# EasyEDA Pro project 3SE_24_Power_Rune.eprj, board Armour (continued)
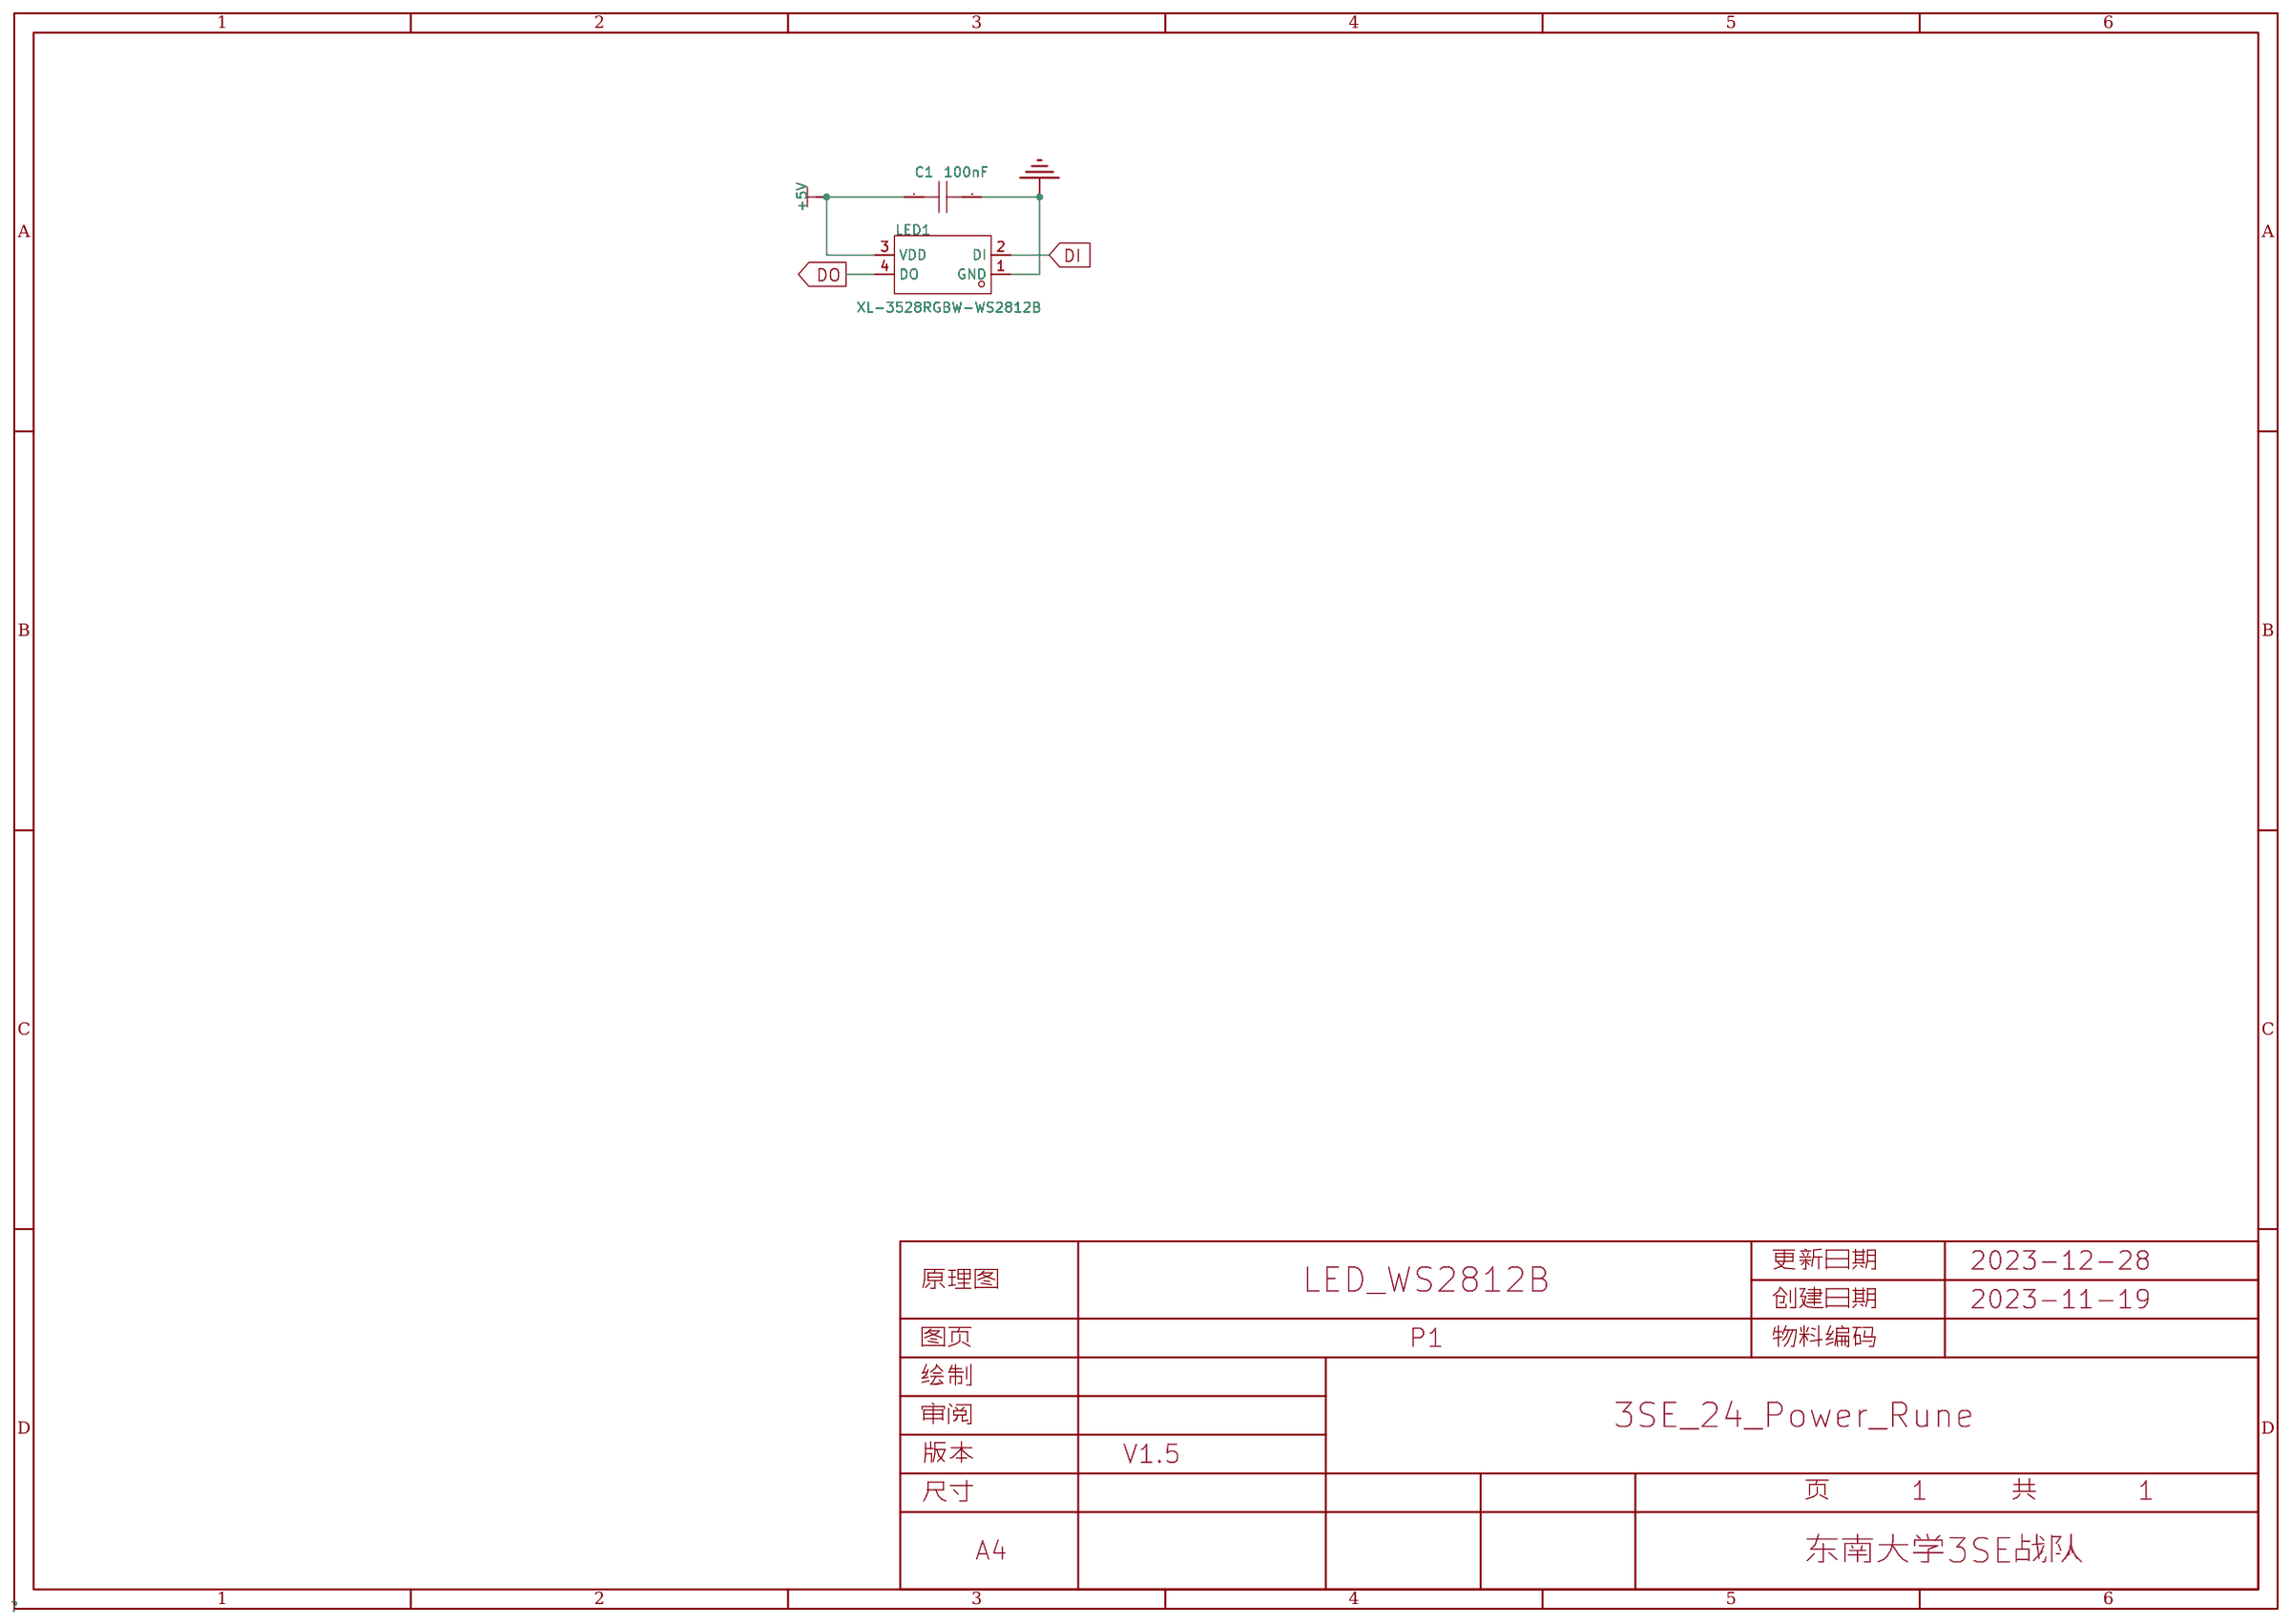
[diagram p0: schematic sheet]
## Routing (per net, layer and track width the routed paths; a pad name or vN(x,y) marks a point on that pad's centre or on a via; arc(x,y) is an arc through that point) (continued)
$1N27067: length 14.6
  Top Layer w0.254: LED94.2 169.77,307.99 LED93.4
$1N27068: length 14.3
  Top Layer w0.254: LED94.4 164.3,304.25 LED95.2
$1N27069: length 24.2
  Top Layer w0.254: LED96.2 132.82,295.24 133.83,296.25 133.83,300.86 136.2,303.23 149.83,303.23 LED95.4
$1N27071: length 16.2
  Top Layer w0.254: LED93.2 187.6,309.49 191,306.09 201.33,306.09 LED92.4
$1N27073: length 16.6
  Top Layer w0.254: LED97.4 118.12,283.26 111.23,276.37 107.87,276.37 LED98.2
$1N27074: length 16.3
  Top Layer w0.254: LED98.4 99.47,269.8 99.47,264.8 97.79,263.11 LED99.2
$1N27075: length 22
  Top Layer w0.254: LED96.4 136.14,296.75 136.63,296.25 136.63,293.59 131.04,288 LED97.2
$1N27077: length 19.7
  Top Layer w0.254: LED88.4 262.38,275.03 258.03,279.38 258.03,286.05 256.08,288 LED89.2
$1N29007: length 21.9
  Top Layer w0.254: LED101.2 78.34,229.64 78.62,229.92 78.62,231.99 79.82,233.19 79.82,237.12 78.91,238.04 78.91,241.7 LED100.4
$1N29008: length 19.7
  Top Layer w0.254: LED101.4 80.86,231.14 81.36,230.64 81.36,219.81 LED102.2
$1N29009: length 18.9
  Top Layer w0.254: LED103.2 77.36,199.6 77.36,207.63 73.13,211.86 LED102.4
$1N29011: length 17.4
  Top Layer w0.254: LED105.2 79.9,168.08 73.13,174.84 LED104.4
$1N29012: length 23.5
  Top Layer w0.254: LED105.4 77.93,161.79 78.76,160.96 78.76,146.59 81.78,143.57 LED106.2
$1N29013: length 18.3
  Top Layer w0.254: LED107.2 96.23,137.04 88.21,145.07 LED106.4
$1N29015: length 17.9
  Top Layer w0.254: LED103.4 71.75,190.5 76.13,186.12 LED104.2
$1N29017: length 28.6
  Top Layer w0.254: LED108.4 106.74,113.9 108.73,113.9 115.54,107.08 115.54,102.38 116.61,101.32 118.35,101.32 119.74,102.71 119.74,105.14 120.58,105.97 LED109.2
$1N29018: length 30
  Top Layer w0.254: LED109.4 117.61,104.47 116.6,105.49 116.6,107.62 118.94,109.96 124.85,109.96 134.86,99.96 LED110.2
$1N29019: length 21
  Top Layer w0.254: LED107.4 98.47,124.12 103.82,124.12 107.7,120.25 LED108.2
$1N29021: length 15.5
  Top Layer w0.254: LED100.2 93.23,254.52 LED99.4
$1N29157: length 19.4
  Top Layer w0.254: LED112.2 169.65,88.66 168.67,89.65 LED111.4
$1N29158: length 26.1
  Top Layer w0.254: LED112.4 171.62,79.4 183.88,79.4 185.76,81.28 185.76,83.55 186.7,84.49 LED113.2
$1N29159: length 36.3
  Top Layer w0.254: LED114.2 204.13,85.87 203.18,84.92 203.18,82.83 200.74,80.39 197.29,80.39 194.55,83.12 194.55,86.07 192.09,88.54 184.94,88.54 182.48,86.07 182.48,83.99 183.48,82.99 LED113.4
$1N29161: length 24.1
  Top Layer w0.254: LED116.2 238.7,97.21 237.58,96.09 237.58,91.53 235.7,89.65 LED115.4
$1N29162: length 40
  Top Layer w0.254: LED116.4 235.72,95.71 234.27,97.15 234.27,99.1 245.56,110.4 256.58,110.4 257.61,109.37 257.61,107 256.58,105.97 LED117.2
$1N29163: length 29.4
  Top Layer w0.254: LED117.4 253.38,101.47 258.81,101.47 265.26,107.92 265.26,116.74 265.96,117.44 LED118.2
$1N29165: length 24.8
  Top Layer w0.254: LED115.2 217.49,88.15 216.78,88.86 200.2,88.86 199.33,87.98 199.33,85.25 200.2,84.37 LED114.4
$1N29167: length 23.7
  Top Layer w0.254: LED119.4 274.75,129.36 273.1,131.01 273.1,138.76 278.01,143.67 LED120.2
$1N29168: length 22.8
  Top Layer w0.254: LED121.2 295.07,162.85 296.64,161.28 296.64,155.93 292.42,151.71 292.42,150.41 LED120.4
$1N29169: length 29.1
  Top Layer w0.254: LED118.4 261.97,115.94 261.9,115.87 260.68,117.09 260.68,118.62 268.09,126.04 275.02,126.04 276.81,127.83 276.81,129.99 277.69,130.87 278.26,130.87 LED119.2
$1N29171: length 29.3
  Top Layer w0.254: LED111.2 149.98,88.15 148.99,89.14 148.99,95.65 145.5,99.14 140.25,99.14 135.82,94.71 133.03,94.71 LED110.4
$1N29307: length 24.3
  Top Layer w0.254: LED123.2 285.74,196.99 293.63,189.1 293.63,179.22 294.96,177.89 LED122.4
$1N29308: length 23.7
  Top Layer w0.254: LED124.2 284.3,213.92 285.36,212.86 285.36,205.75 279.43,199.81 279.43,197.24 281.18,195.49 LED123.4
$1N29309: length 13.2
  Top Layer w0.254: LED125.2 277.23,223.17 277.23,214.27 279.08,212.42 LED124.4
$1N29311: length 19.4
  Top Layer w0.254: LED127.2 263.06,259.66 267.19,255.53 267.19,244.85 267.8,244.24 LED126.4
$1N29312: length 19.2
  Top Layer w0.254: LED127.4 257.13,258.16 251.96,263.33 251.96,271.06 251.39,271.63 249.96,271.63 LED128.2
$1N29313: length 18
  Top Layer w0.254: LED129.2 237.26,281.42 239.56,279.13 239.56,274.98 244.36,270.17 LED128.4
$1N29315: length 27.2
  Top Layer w0.254: LED126.2 272.82,245.74 272.91,245.83 273.63,245.11 273.63,243.14 272.5,242.01 272.5,232.81 274.91,230.41 276.67,230.41 280.58,226.5 LED125.4
$1N29317: length 9.4
  Top Layer w0.254: LED131.2 206.18,293 210.21,288.98 LED130.4
$1N29318: length 15.2
  Top Layer w0.254: LED132.2 187.5,294.49 190.48,291.5 LED131.4
$1N29319: length 27.3
  Top Layer w0.254: LED129.4 232.3,279.23 220.37,279.23 218.65,280.94 218.65,288.28 216.45,290.48 LED130.2
$1N29321: length 23.8
  Top Layer w0.254: LED122.2 297.71,179.39 296.77,178.44 296.77,175.75 289.33,168.31 289.33,162.18 290.16,161.35 LED121.4
$1N29457: length 9.5
  Top Layer w0.254: LED133.4 164.57,288.75 161.2,288.75 LED134.2
$1N29458: length 23.7
  Top Layer w0.254: LED135.2 139.97,282.9 154.95,282.9 156.64,284.59 LED134.4
$1N29459: length 14.3
  Top Layer w0.254: LED135.4 127.25,271.67 LED136.2
$1N29461: length 15.2
  Top Layer w0.254: LED138.2 109.56,252.48 LED137.4
$1N29462: length 30.8
  Top Layer w0.254: LED139.2 91.88,223.79 92.52,224.43 92.52,226.44 94.48,228.4 99.97,228.4 103.33,231.76 103.33,240.72 LED138.4
$1N29463: length 14.1
  Top Layer w0.254: LED139.4 94.57,225.29 95.48,224.38 95.48,218.16 LED140.2
$1N29465: length 15.9
  Top Layer w0.254: LED137.2 115.29,259.66 121.58,265.94 LED136.4
$1N29467: length 17.3
  Top Layer w0.254: LED141.4 86.75,190.89 91.23,186.4 LED142.2
$1N29468: length 12.5
  Top Layer w0.254: LED142.4 89.27,178.55 93.95,173.88 93.95,169.3 LED143.2
$1N29469: length 17.1
  Top Layer w0.254: LED140.4 88.23,210.49 91.04,207.69 91.04,198.28 LED141.2
$1N29471: length 13.9
  Top Layer w0.254: LED132.4 170.34,292.99 LED133.2
$1N29607: length 29.4
  Top Layer w0.254: LED144.4 99.81,136.48 106.64,129.66 110.13,129.66 111.16,130.68 111.16,133.48 112,134.31 LED145.2
$1N29608: length 31.9
  Top Layer w0.254: LED146.2 124.58,126.52 113.08,138.02 108.79,138.02 107.67,136.9 107.67,133.61 108.46,132.81 LED145.4
$1N29609: length 22.1
  Top Layer w0.254: LED147.2 138.5,115.52 134.85,119.17 123.21,119.17 LED146.4
$1N29611: length 15.8
  Top Layer w0.254: LED148.4 159.69,103.54 165.83,97.4 167.71,97.4 168.83,98.52 168.83,99.88 169.92,100.97 LED149.2
$1N29612: length 31.1
  Top Layer w0.254: LED149.4 166.61,99.47 165.79,100.29 165.79,103.01 167.63,104.85 185.18,104.85 187.41,102.62 187.41,99.65 LED150.2
$1N29613: length 25.4
  Top Layer w0.254: LED150.4 187.44,94.8 199.98,94.8 202.86,97.68 202.86,100.36 203.32,100.82 204.03,100.82 LED151.2
$1N29615: length 27.3
  Top Layer w0.254: LED148.2 154.48,100.19 144.35,100.19 135.5,109.04 LED147.4
$1N29617: length 27.8
  Top Layer w0.254: LED152.4 215.23,107.74 216.75,109.26 233.69,109.26 234.37,109.94 234.37,111.44 235.48,112.55 LED153.2
$1N29618: length 30.1
  Top Layer w0.254: LED154.2 249.07,122.3 248.33,121.56 248.33,119.38 246.18,117.22 232.11,117.22 230.43,115.55 230.43,112.01 231.39,111.05 LED153.4
$1N29619: length 20.8
  Top Layer w0.254: LED151.4 200.08,99.47 198.83,100.72 198.83,102.81 201.48,105.46 208.04,105.46 211.39,102.11 LED152.2
$1N29621: length 25.8
  Top Layer w0.254: LED143.4 90.8,165.55 94.41,161.94 96.9,161.94 102.81,156.02 LED144.2
$1N29757: length 27.5
  Top Layer w0.254: LED156.2 271.11,148.24 270.24,147.37 270.24,145.53 269.32,144.61 262.48,144.61 256.46,138.59 256.46,134.56 258.2,132.81 LED155.4
$1N29758: length 33.8
  Top Layer w0.254: LED156.4 267.77,146.74 266.64,147.87 266.64,155.11 269.33,157.8 270.26,157.8 274.01,161.55 278.37,161.55 282.02,165.2 282.02,167.91 281.29,168.65 LED157.2
$1N29759: length 23.2
  Top Layer w0.254: LED158.2 282.39,180.05 281.6,179.27 281.6,177.22 277.98,173.6 274.39,173.6 273.39,172.6 273.39,168.15 274.39,167.15 LED157.4
$1N29761: length 21.1
  Top Layer w0.254: LED159.4 264.79,195.49 263.18,197.1 263.18,204.04 267.07,207.93 267.07,210.72 267.67,211.31 LED160.2
$1N29762: length 18.7
  Top Layer w0.254: LED161.2 265.2,225.2 266.1,224.31 266.1,219.41 263.64,216.95 263.64,210.38 264.2,209.81 LED160.4
$1N29763: length 16.8
  Top Layer w0.254: LED162.2 259.59,238.24 260.24,237.59 260.24,224.48 261.01,223.7 LED161.4
$1N29765: length 25.8
  Top Layer w0.254: LED159.2 269.04,196.99 268.42,196.37 268.42,194.56 273.2,189.78 273.2,183.04 277.69,178.55 LED158.4
$1N29767: length 25
  Top Layer w0.254: LED164.2 245.44,262.23 251.33,256.34 251.33,249.08 LED163.4
$1N29768: length 11.5
  Top Layer w0.254: LED165.2 229.51,268.43 231.14,266.8 231.14,263.45 233.87,260.73 LED164.4
$1N29769: length 12.7
  Top Layer w0.254: LED163.2 249.43,246.12 249.43,242.28 254.97,236.74 LED162.4
$1N29771: length 26.7
  Top Layer w0.254: LED154.4 245.56,120.8 245.22,121.14 245.22,123.9 251.39,130.06 258.72,130.06 260.52,131.87 260.52,133.68 261.16,134.31 LED155.2
$1N29907: length 13.1
  Top Layer w0.254: LED167.2 205.12,278.23 210.34,273.01 LED166.4
$1N29908: length 12.9
  Top Layer w0.254: LED168.2 187.61,279.49 190.9,276.19 198.04,276.19 LED167.4
$1N29909: length 11.4
  Top Layer w0.254: LED169.2 173.17,277.99 LED168.4
$1N29911: length 11.9
  Top Layer w0.254: LED170.4 155.91,272.88 151.65,272.88 147.2,268.43 LED171.2
$1N29912: length 8.7
  Top Layer w0.254: LED172.2 137.66,261.6 LED171.4
$1N29913: length 24.2
  Top Layer w0.254: LED173.2 119.77,246.78 120.2,247.2 120.2,249.08 121.06,249.94 122.93,249.94 124.36,251.36 124.36,255.95 128.51,260.1 LED172.4
$1N29915: length 11.8
  Top Layer w0.254: LED169.4 167.7,274.51 LED170.2
$1N29917: length 17.4
  Top Layer w0.254: LED175.2 112.75,225.2 116.2,228.66 116.2,230.62 112.8,234.02 LED174.4
$1N29918: length 12.7
  Top Layer w0.254: LED175.4 106.72,212.03 LED176.2
$1N29919: length 19.7
  Top Layer w0.254: LED173.4 121.88,248.04 123.07,248.04 124.41,246.7 124.41,239.57 123.07,238.24 LED174.2
$1N29921: length 15
  Top Layer w0.254: LED165.4 224.57,266.93 224.06,267.44 224.06,270.61 220.16,274.51 LED166.2
$1N31113: length 14.6
  Top Layer w0.254: LED177.4 101.75,189.75 106,185.5 LED178.2
$1N31114: length 15.2
  Top Layer w0.254: LED179.2 109.72,174.44 LED178.4
$1N31115: length 15.8
  Top Layer w0.254: LED179.4 107.65,167.27 115.8,159.11 LED180.2
$1N31117: length 23.4
  Top Layer w0.254: LED182.2 132.49,130.39 131.89,130.99 131.89,133.32 130.09,135.12 125.87,135.12 118.77,142.21 LED181.4
$1N31118: length 14
  Top Layer w0.254: LED183.2 146,128.77 142.88,131.89 LED182.4
$1N31119: length 19.8
  Top Layer w0.254: LED184.2 159.5,119.93 159.5,121.6 157.79,123.31 143.73,123.31 LED183.4
$1N31121: length 14
  Top Layer w0.254: LED181.2 121.74,146.16 121.74,149.01 119.75,151 116.04,151 LED180.4
$1N31123: length 33.6
  Top Layer w0.254: LED185.4 169.02,114.24 167.1,116.16 167.1,117.14 169.46,119.5 178.54,119.5 182.48,115.56 182.48,112.12 183.27,111.33 185.27,111.33 185.83,111.88 185.83,113.9 186.42,114.49 LED186.2
$1N31124: length 27.6
  Top Layer w0.254: LED186.4 183.78,112.99 183.15,113.61 183.15,116.54 186.52,119.91 200.37,119.91 201.58,118.7 LED187.2
$1N31125: length 21.8
  Top Layer w0.254: LED185.2 172.34,115.74 171.42,114.82 171.42,113.83 169.25,111.67 162.33,111.67 LED184.4
$1N31127: length 15
  Top Layer w0.254: LED176.4 106.55,206.26 106.55,198.79 LED177.2
$1N31263: length 22
  Top Layer w0.254: LED188.4 213.89,116.54 221.62,116.54 227.02,121.94 227.02,124.7 227.86,125.54 LED189.2
$1N31264: length 17.1
  Top Layer w0.254: LED189.4 224.53,124.04 224.02,124.55 224.02,127.01 227.32,130.31 LED190.2
$1N31265: length 22.9
  Top Layer w0.254: LED191.2 251.84,145.44 251.07,144.67 251.07,143.26 250.22,142.4 248.5,142.4 246.62,140.52 246.62,136.61 241.82,131.81 LED190.4
$1N31267: length 21.5
  Top Layer w0.254: LED192.4 254.4,154.24 253.55,155.09 253.55,157.51 263.18,167.14 263.18,168.39 263.56,168.77 LED193.2
$1N31268: length 24.6
  Top Layer w0.254: LED193.4 261.65,167.4 259.98,167.4 259.36,168.02 259.36,171.14 260.27,172.05 263.12,172.05 270.1,179.03 270.1,181.78 269.22,182.66 LED194.2
$1N31269: length 21.3
  Top Layer w0.254: LED195.2 256.31,196.99 257.51,195.79 257.51,188.96 265.31,181.16 LED194.4
$1N31271: length 21.6
  Top Layer w0.254: LED192.2 258.14,155.74 257.22,154.82 257.22,152.66 255.62,151.06 250.5,151.06 247.37,147.93 247.37,144.99 248.42,143.94 LED191.4
$1N31273: length 20.3
  Top Layer w0.254: LED196.4 248.47,212.96 247.13,214.29 247.13,230 246.4,230.74 LED197.2
$1N31275: length 20.9
  Top Layer w0.254: LED196.2 251.64,214.46 250.62,213.44 250.62,196.18 251.31,195.49 LED195.4
$1N31277: length 27.3
  Top Layer w0.254: LED187.4 198.58,113.56 199.95,112.19 202.61,112.19 207.02,116.6 207.02,119.03 211.24,123.25 214.46,123.25 215.47,122.24 LED188.2
$1N31413: length 16.7
  Top Layer w0.254: LED198.4 214.32,253.94 206.08,262.19 LED199.2
$1N31414: length 16
  Top Layer w0.254: LED200.2 187.68,264.49 191.48,260.69 LED199.4
$1N31415: length 14.8
  Top Layer w0.254: LED200.4 183.45,262.19 LED201.2
$1N31419: length 16.5
  Top Layer w0.254: LED204.2 126.05,218.45 126.05,228.98 LED203.4
$1N31421: length 15.5
  Top Layer w0.254: 153.5,255.44 161.54,255.44 LED201.4
$1N31423: length 18.2
  Top Layer w0.254: LED206.2 122.05,185.73 116.75,191.03 LED205.4
$1N31424: length 18.8
  Top Layer w0.254: LED207.2 128.79,166.87 119.05,176.62 LED206.4
$1N31425: length 18.5
  Top Layer w0.254: LED205.2 122.51,199.75 122.51,206.09 119.05,209.55 LED204.4
$1N31564: length 27.3
  Top Layer w0.254: 150.5,137.03 150.5,134.35 152.89,131.96 160.71,131.96 163.95,135.2 169.15,135.2 169.78,134.57 LED209.2
$1N31565: length 28.8
  Top Layer w0.254: LED210.2 187.25,132.86 185.77,134.34 178.09,134.34 171.39,127.64 168.6,127.64 166.78,129.46 LED209.4
$1N31567: length 32
  Top Layer w0.254: LED211.4 199.51,130.29 198.68,131.12 198.68,134.83 199.69,135.83 219.12,135.83 219.39,136.1 219.39,137.88 220.04,138.53 LED212.2
$1N31571: length 24.9
  Top Layer w0.254: LED210.4 185.83,126.41 200.95,126.41 203.18,128.64 203.18,131.35 203.62,131.79 LED211.2
$1N31573: length 24.5
  Top Layer w0.254: LED215.2 241.31,196.99 247.2,191.1 247.2,179.24 248.42,178.01 LED214.4
$1N31574: length 19.4
  Top Layer w0.254: LED216.2 238.69,210.57 239.6,209.67 239.6,206.84 234.81,202.05 234.81,196.7 236.02,195.49 LED215.4
$1N31575: length 25.6
  Top Layer w0.254: LED213.4 241.24,161.74 239.97,163.01 239.97,166.8 250.96,177.79 250.96,179.17 251.31,179.52 LED214.2
$1N31715: length 12.5
  Top Layer w0.254: LED219.2 202.66,247.7 209.4,240.95 LED218.4
$1N31717: length 10.7
  Top Layer w0.254: LED221.2 183.96,247.7 LED220.4
$1N31718: length 12
  Top Layer w0.254: LED221.4 166.4,241.94 160.52,241.94 LED222.2
$1N31721: length 12
  Top Layer w0.254: LED219.4 190.63,246.2 187.34,249.49 LED220.2
$1N31723: length 12.1
  Top Layer w0.254: LED224.2 138.78,212.82 LED223.4
$1N31724: length 13.2
  Top Layer w0.254: LED225.2 134.87,196.99 135.43,197.54 135.43,207.19 LED224.4
$1N31727: length 16.6
  Top Layer w0.254: LED217.2 231.34,221.86 231.34,211.99 234.25,209.07 LED216.4
$1N31863: length 15.1
  Top Layer w0.254: LED226.4 134.42,181.9 141.78,174.53 LED227.2
$1N31867: length 21.3
  Top Layer w0.254: LED229.4 175.52,139.92 183.24,139.92 185.64,142.32 185.64,143.64 186.49,144.49 LED230.2
$1N31868: length 29.1
  Top Layer w0.254: LED231.2 199.88,146.27 199.27,145.67 199.27,143.73 198.52,142.99 195.53,142.99 190.5,148.02 183.44,148.02 181.96,146.54 181.96,144.4 183.37,142.99 LED230.4
$1N31869: length 30.3
  Top Layer w0.254: LED231.4 196.52,144.77 196.1,145.2 196.1,147.8 197.87,149.57 201.16,149.57 206.15,144.59 210.37,144.59 212,146.21 212,150.84 212.68,151.52 LED232.2
$1N31871: length 24.8
  Top Layer w0.254: LED228.4 155.82,150.2 160.12,145.91 165.11,145.91 169.68,150.47 172.07,150.47 173.66,148.88 LED229.2
$1N31874: length 28.2
  Top Layer w0.254: LED234.2 237.18,183.4 236.5,182.72 236.5,167.01 234.81,165.32 230.81,165.32 229.72,166.41 LED233.4
$1N31877: length 14.1
  Top Layer w0.254: LED226.2 136.54,190.7 LED225.4
$1N32013: length 21.1
  Top Layer w0.254: LED236.2 217.34,198.44 220.29,195.49 LED235.4
$1N32014: length 25.6
  Top Layer w0.254: LED237.2 214.74,229.67 220.34,224.06 LED236.4
$1N32015: length 19.6
  Top Layer w0.254: LED237.4 191.66,228.17 188.99,230.84 188.99,233.64 188.14,234.49 LED238.2
$1N32017: length 27.6
  Top Layer w0.254: LED239.4 164.77,227.96 162.9,229.84 156.68,229.84 152.89,226.05 152.89,215.23 152.11,214.44 LED240.2
$1N32018: length 29.9
  Top Layer w0.254: 146.52,195.75 145,197.27 145,198.38 145.77,199.15 151.91,199.15 155.92,203.16 155.92,215.06 155.04,215.94 LED240.4
$1N32019: length 20.5
  Top Layer w0.254: LED242.2 154.54,178.55 154.54,187.69 151.31,190.92 151.31,195.46 LED241.4
$1N32021: length 17.2
  Top Layer w0.254: LED239.2 180.73,229.46 LED238.4
$1N32023: length 27.8
  Top Layer w0.254: LED244.2 186.28,159.49 185.79,159 185.79,157.06 184.36,155.62 172.8,155.62 170.8,157.62 170.8,163.27 169.82,164.26 LED243.4
$1N32024: length 25
  Top Layer w0.254: LED245.2 184.22,162.64 182.83,161.25 182.83,158.51 183.35,157.99 LED244.4
$1N32025: length 26
  Top Layer w0.254: LED243.2 165.98,162.62 156.68,162.62 151.5,167.81 LED242.4
$1N32027: length 20.2
  Top Layer w0.254: LED234.4 234.4,181.9 233.44,182.86 233.44,189.19 225.64,196.99 LED235.2
$1N32163: length 24.5
  Top Layer w0.254: LED246.4 216.16,176.74 215.21,177.69 215.21,193.25 211.47,196.99 LED247.2
$1N32164: length 15
  Top Layer w0.254: LED248.2 206.05,208.24 205.17,207.36 205.17,196.14 205.82,195.49 LED247.4
$1N32165: length 15
  Top Layer w0.254: LED249.2 200.28,216.47 200.7,216.06 200.7,214.38 199.01,212.69 199.01,210.28 202.55,206.74 LED248.4
$1N32167: length 38.9
  Top Layer w0.254: LED250.4 183.31,217.05 183.31,213.35 175.58,205.62 172.17,205.62 167.85,201.3 167.85,200.62 166.33,199.11 161.19,199.11 160.2,198.12 160.2,195.8 160.57,195.43 161.67,195.43 LED251.2
$1N32168: length 13
  Top Layer w0.254: LED251.4 165.49,196.98 166.23,196.24 166.23,190.01 167.76,188.48 LED252.2
$1N32169: length 32.8
  Top Layer w0.254: LED253.2 175.22,177.5 174.25,176.53 174.25,169.25 172.86,167.87 169.96,167.87 167.99,169.84 167.99,175.23 164.76,178.45 LED252.4
$1N32171: length 10.1
  Top Layer w0.254: LED250.2 187.7,219.49 192.21,214.97 LED249.4
$1N32173: length 11.6
  Top Layer w0.254: LED255.2 183.01,181.94 183.01,173.54 183.56,172.99 LED254.4
$1N32174: length 19.2
  Top Layer w0.254: LED256.2 198.82,196.99 197.88,196.04 197.88,195.21 196.1,193.43 195.27,193.43 192.66,190.82 192.66,188.25 189.09,184.69 LED255.4
$1N32175: length 30.3
  Top Layer w0.254: LED254.2 186.65,174.49 185.69,173.53 185.69,170.75 185.23,170.3 183.4,170.3 182.26,171.44 182.26,175.5 177.68,180.08 172.29,180.08 171.35,179.13 171.35,176.94 172.29,176 LED253.4
$1N32177: length 23.3
  Top Layer w0.254: LED245.4 208.42,164.14 211.56,167.28 213.94,167.28 218.05,171.39 218.05,177.46 218.83,178.24 LED246.2
$1N32313: length 21.4
  Top Layer w0.254: LED257.4 183.89,207.43 183.89,205.93 176.75,198.79 171.69,198.79 170.85,197.94 170.85,196.42 171.8,195.47 LED258.2
$1N32327: length 21.1
  Top Layer w0.254: LED256.4 195.93,195.49 195.09,196.33 195.09,207.06 192.86,209.29 LED257.2
$1N36301: length 33.6
  Top Layer w0.254: LED217.4 228.77,221.74 227.94,222.56 227.94,237.64 223.12,242.45 LED218.2
$1N36307: length 32.1
  Top Layer w0.254: 158,240.95 146.37,240.95 140.84,235.43 140.84,227.44 141.91,226.38 141.91,223.36 LED223.2
$1N36310: length 30.9
  Top Layer w0.254: LED228.2 158.82,157.95 152.2,164.56 143.45,164.56 LED227.4
$1N36313: length 42.3
  Top Layer w0.254: LED233.2 232.72,173.88 232.26,174.34 228.61,174.34 207.91,153.64 207.91,151.16 208.88,150.19 210.33,150.19 LED232.4
$1N36316: length 38.4
  Top Layer w0.254: 221,255.44 221.6,255.44 224.7,252.35 224.7,246.84 228.01,243.52 228.01,239.14 237.91,229.24 LED197.4
$1N36322: length 35.4
  Top Layer w0.254: LED202.4 150.5,246.93 142.3,238.73 136.79,238.73 LED203.2
$1N36325: length 39.5
  Top Layer w0.254: LED208.2 153.5,142.33 138.26,157.57 129.96,157.57 LED207.4
$1N36331: length 53.3
  Top Layer w0.254: LED213.2 246.43,163.24 246.93,162.74 246.93,159.5 241.64,154.21 235.28,154.21 230.97,149.9 230.97,145.75 228.9,143.68 216.91,143.68 214.84,141.61 214.84,138.85 216.66,137.03 218,137.03
$1N36334: length 44.8
  Top Layer w0.254: LED70.4 126.25,79.32 133.47,79.32 135.77,81.62 151.07,81.62 156.78,75.91 156.78,73.65 LED71.2
$1N36337: length 55.4
  Top Layer w0.254: 292.38,127.92 290.5,127.92 288.9,129.53 288.9,135.36 295.2,141.66 295.2,147.99 297.01,149.8 297.01,152.93 303.64,159.56 303.64,164.24 304.79,165.39 309.38,165.39 310.45,164.32 310.45,162.48 LED81.2
$1N36340: length 33.9
  Top Layer w0.254: LED54.4 152.72,318.52 145.5,311.3 138.12,311.3 134.23,307.4 LED55.2
$1N36343: length 41.9
  Top Layer w0.254: LED3.4 321.11,232.37 318.64,234.84 318.64,238.01 310.35,246.3 310.35,256.97 309.72,257.6 309.72,267.6 310.35,268.24 LED4.2
$1N36346: length 40.7
  Top Layer w0.254: LED9.2 243.58,334.63 251.21,327 251.21,322.15 254.47,318.89 LED8.4
$1N36349: length 38.4
  Top Layer w0.254: LED13.4 131.86,333.13 127.76,329.02 127.76,326.04 122.11,320.39 LED14.2
$1N36354: length 43.8
  Top Layer w0.254: LED24.2 63.84,128.31 58.93,133.23 52.39,133.23 46.6,139.01 LED23.4
$1N36357: length 38.5
  Top Layer w0.254: LED19.2 49.69,233.87 52.54,236.72 52.54,248.28 51.44,249.38 51.44,252.6 60.84,262 LED18.4
$1N36363: length 53.7
  Top Layer w0.254: LED28.4 112.13,72.08 111.56,72.65 111.56,76.59 112.25,77.28 121.7,77.28 127.43,71.54 140.84,71.54 150.37,62.02 LED29.2
$1N36372: length 62.6
  Top Layer w0.254: LED33.4 219.07,57.84 217.78,59.13 217.78,60.89 218.76,61.87 247.25,61.87 248.69,63.31 248.69,73.23 252.92,77.46 257.42,77.46 258.85,76.03 258.85,73.93 LED34.2
$1N36387: length 55.9
  Top Layer w0.254: LED38.4 305.49,124.24 303.65,126.07 303.65,131.83 305.49,133.67 318.75,133.67 323.67,138.59 323.67,159.75 324.03,160.1 LED39.2
$11N923: length 1.8
  Top Layer w0.254: R28.2 333.87,215.49 333.87,216.9 334.14,217.17
$11N2441: length 9.8
  Top Layer w0.254: R1.1 31.58,216.54 27.09,216.54 U1.2
  Top Layer w0.4: C438.1 33.46,216.48 31.86,216.48 R1.1 31.67,216.67 31.67,218.24
$11N5632: length 4
  Top Layer w0.254: 328.64,226.72 330.31,226.72 X1.1 330.9,226.68 331.5,226.07 332.38,226.07
$11N5639: length 4
  Top Layer w0.254: 332.38,224.8 331.78,224.8 331.24,224.26 330.43,224.26 X1.2 330.33,224.16 328.65,224.16
$11N5674: length 28.4
  Top Layer w0.254: SW3.2 351.37,198.35 351.37,214.19 350.07,215.5 342.18,215.5 341.76,215.91 341.76,217.17
$11N5844: length 1.4
  Top Layer w0.254: R30.1 341.05,208.84 LED431.2
$11N5848: length 14.1
  Top Layer w0.254: v1(341.1,211.38) 341.1,210.49 LED431.1 ; v1(346.85,218.5) 346.85,217.18 346.84,217.17
  Bottom Layer w0.254: v1(346.85,218.5) 342.93,218.5 341.1,216.68 v1(341.1,211.38)
$11N11553: length 6.2
  Top Layer w0.254: 349.66,202.22 349.84,202.39 349.84,206.4 349.59,206.65 348.07,206.65 USB1.4
$11N11554: length 5.8
  Top Layer w0.254: 349.49,213.71 349.88,213.32 349.88,210.11 349.5,209.73 USB1.10
$11N48563: length 12.9
  Top Layer w0.254: C433.1 18.64,225.94 18.64,218.94 19.85,217.73 U1.4
$11N53990: length 5.9
  Top Layer w0.254: USB1.6 348.69,207.73 349.2,208.24 348.71,208.73 USB1.8 347.96,208.69 346.1,208.69 345.63,208.23 345.15,208.23
$11N54016: length 5.4
  Top Layer w0.254: USB1.5 346.91,207.23 ; 346.91,207.23 346.01,206.33 345.15,206.33 ; 346.91,207.23 346.75,207.39 346.75,207.96 347.02,208.23 USB1.7
$12N59: length 27.1
  Top Layer w0.254: LED259.4 337.52,263.32 337.52,269.66 331.3,275.88 329.87,275.88 328.89,276.86 328.89,280.44 329.7,281.25 331.16,281.25 332.23,280.17 332.23,279.96
$12N73: length 27.1
  Top Layer w0.254: 329.77,294.84 329.77,295.05 328.7,296.12 327.24,296.12 326.43,295.31 326.43,291.73 327.41,290.75 328.84,290.75 335.06,284.53 335.06,278.2 334.18,277.33
$12N87: length 26.5
  Top Layer w0.254: LED262.2 324.77,312.37 323.98,311.59 323.98,305.96 332.61,297.33 332.61,293 331.74,292.13
$12N101: length 24.5
  Top Layer w0.254: LED262.4 330.16,311.1 330.16,314.08 323.94,320.3 322.51,320.3 321.53,321.28 321.53,324.86 322.34,325.67 323.8,325.67 324.88,324.6 324.88,324.39
$12N115: length 62.2
  Top Layer w0.254: LED264.2 344.54,267.17 337.47,274.25 337.47,286.94 335,289.42 335,302.49 332.06,305.43 332.06,316.45 LED263.4
$12N129: length 27.1
  Top Layer w0.254: LED265.2 342.1,281.8 341.03,282.88 339.57,282.88 338.76,282.06 338.76,278.49 339.74,277.5 341.17,277.5 347.39,271.29 347.39,264.95 346.51,264.08
$12N143: length 27.1
  Top Layer w0.254: 344.05,278.96 344.92,279.83 344.92,286.16 338.7,292.38 337.27,292.38 336.29,293.36 336.29,296.94 337.1,297.75 338.56,297.75 339.64,296.68 339.64,296.47
$12N157: length 27.1
  Top Layer w0.254: 337.19,311.27 337.19,311.48 336.12,312.55 334.66,312.55 333.85,311.74 333.85,308.16 334.83,307.18 336.26,307.18 342.48,300.96 342.48,294.63 341.61,293.76
$12N171: length 27.1
  Top Layer w0.254: 339.16,308.5 340.03,309.38 340.03,315.71 333.81,321.93 332.38,321.93 331.4,322.91 331.4,326.49 332.21,327.3 333.67,327.3 334.74,326.23 334.74,326.02
